# EasyEDA Pro project Cerberus_Sub_Controller_v01.eprj, board Cerberus_Sub_Controller_v01
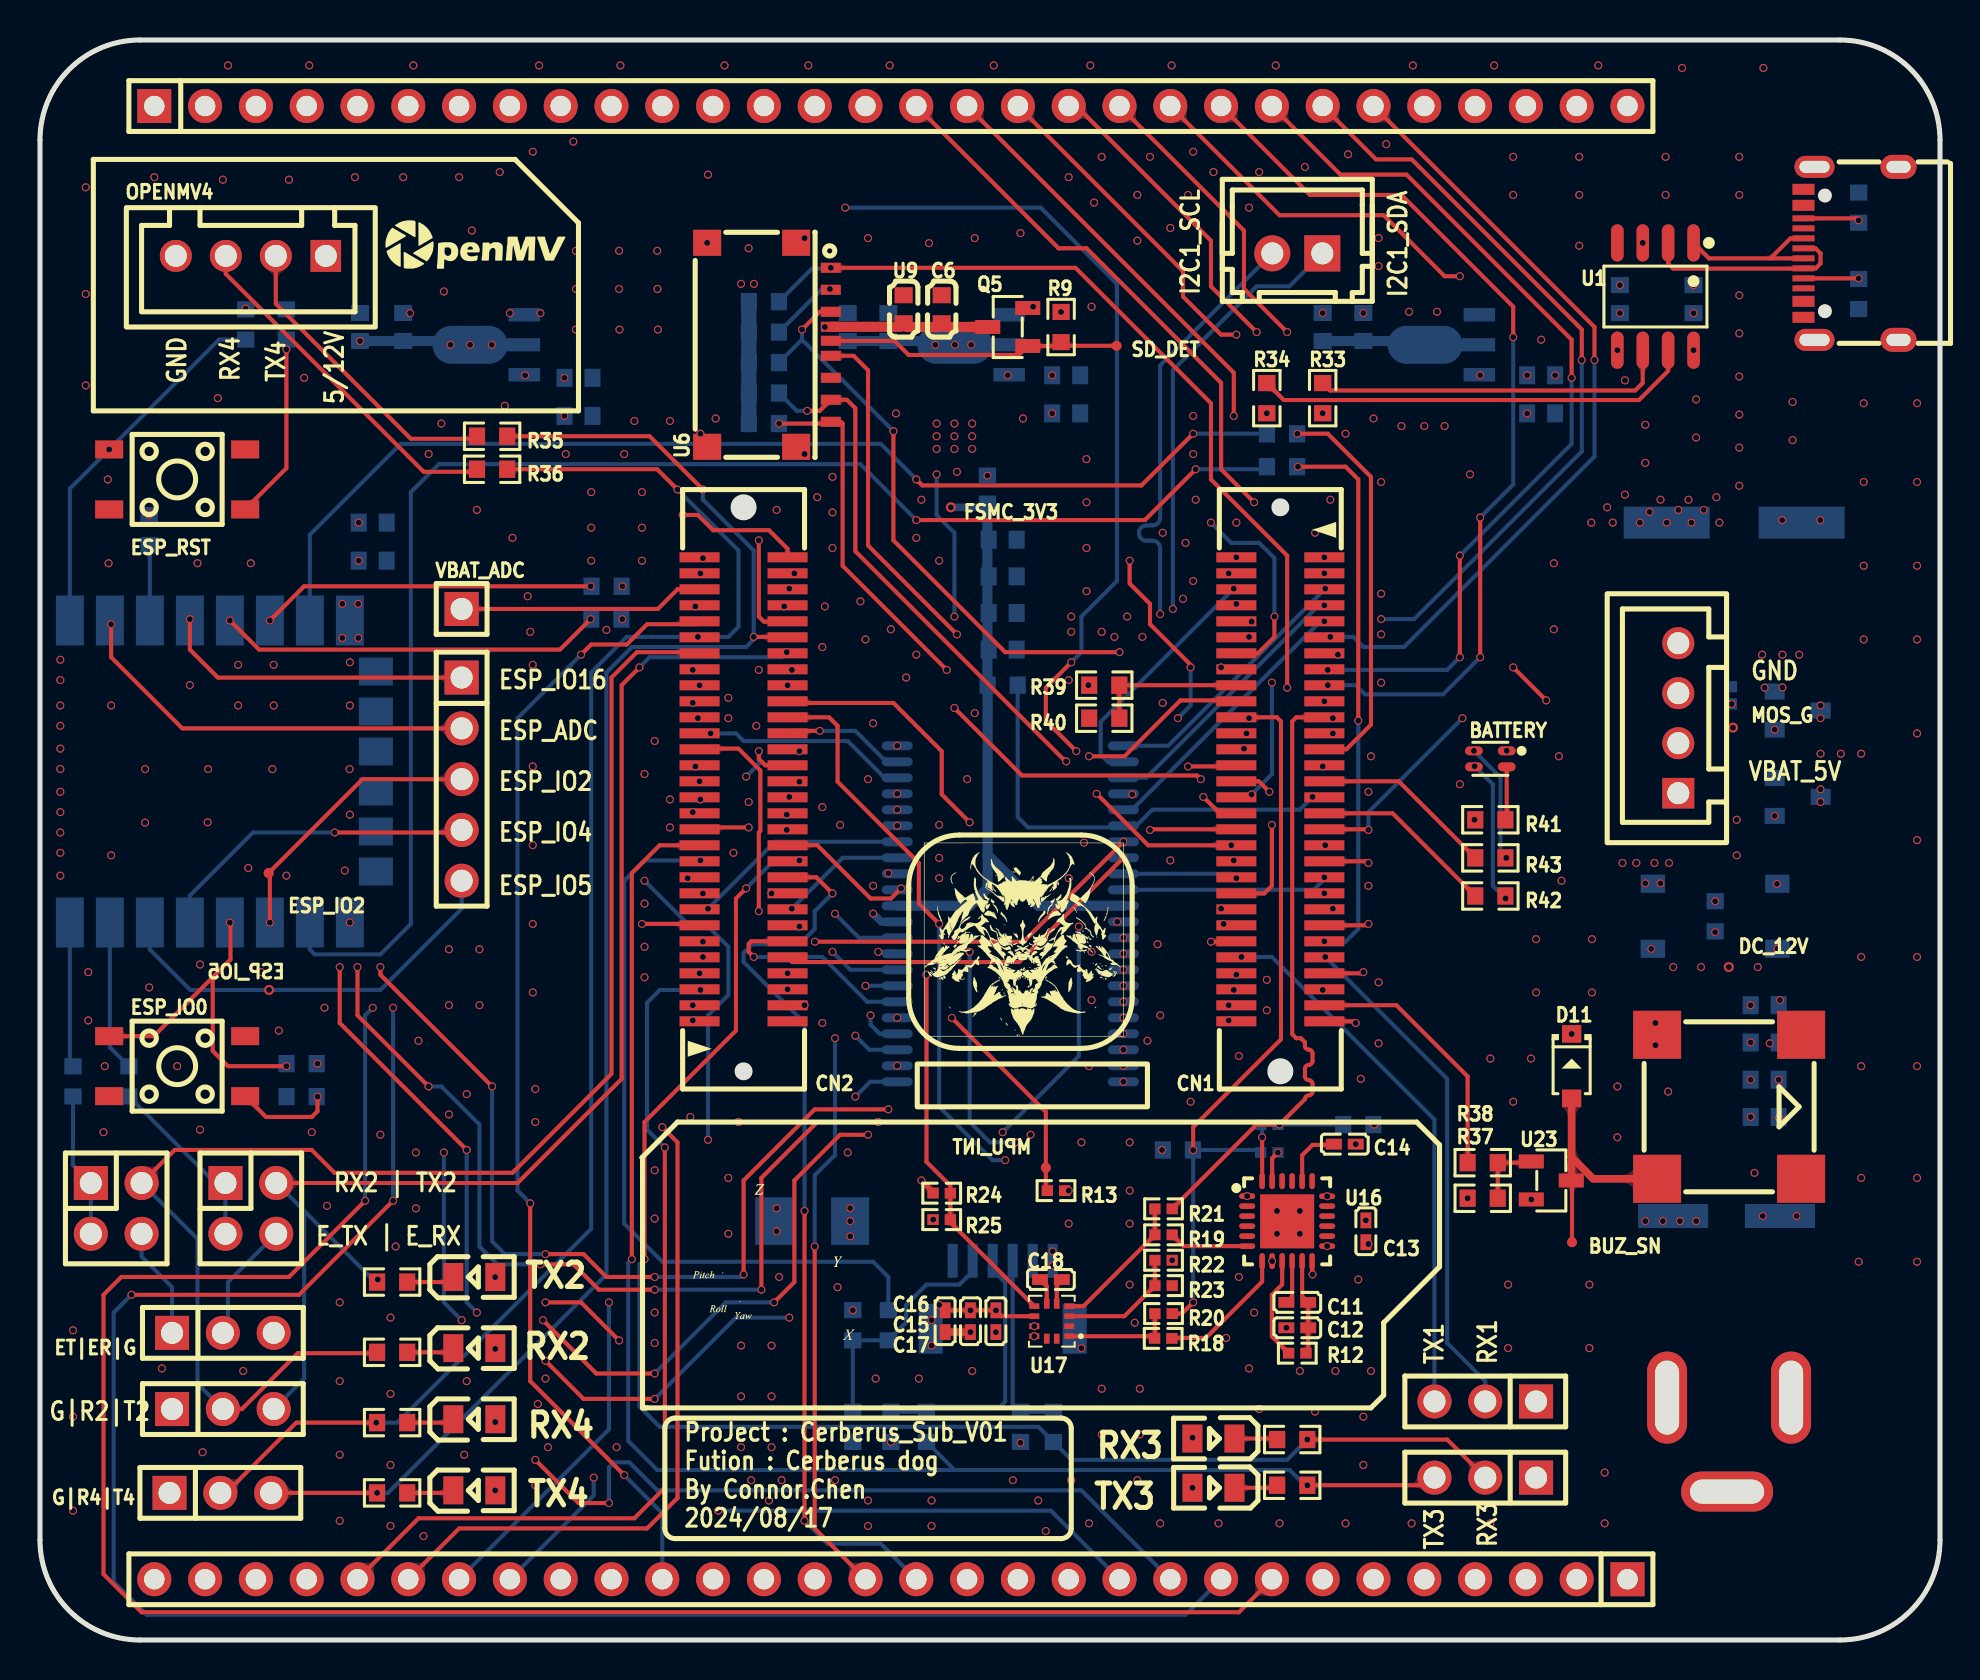
[diagram p4: board, top side]
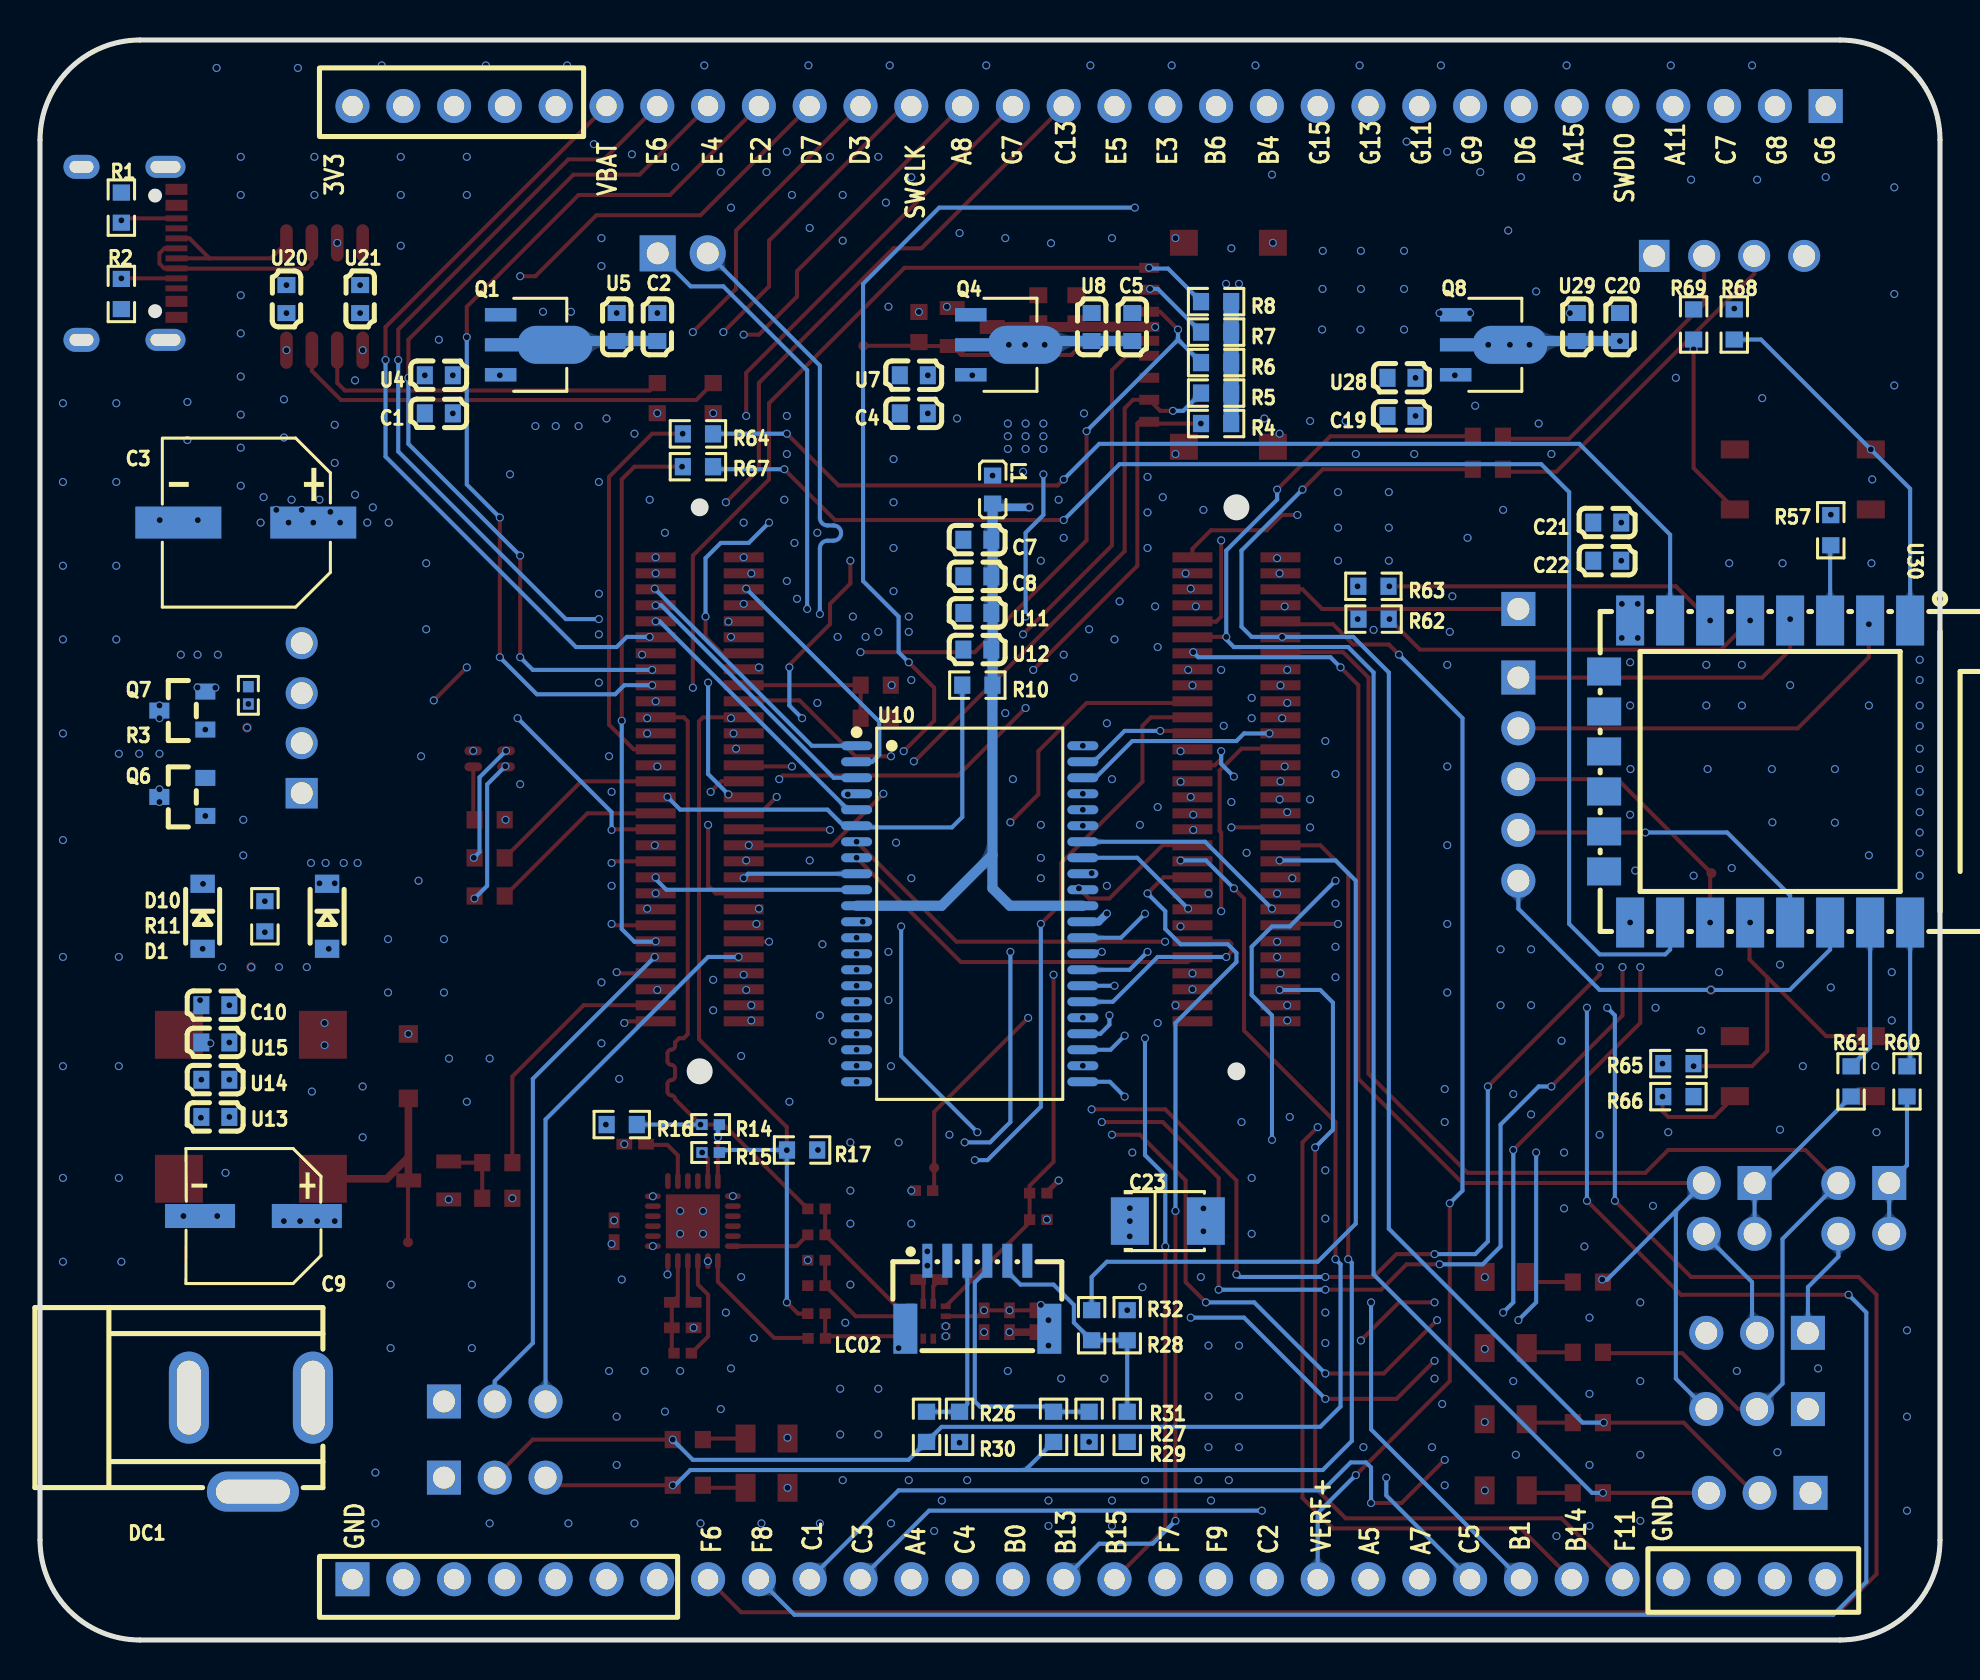
[diagram p5: board, bottom side, seen from below]

Outline 95 x 80 mm; copper layers: Top Layer, SN_IMT, GND, POWER, SN_NRM, Bottom Layer. Coordinates in mm from the lower left corner of the outline.
Outline path: 0,75 0,5 arc(1.46,1.46) 5,0 90,0 arc(93.54,1.46) 95,5 95,75 arc(93.54,78.54) 90,80 5,80 arc(1.46,78.54) 0,75
Stack: Top Layer 0.035mm 外层铜厚1oz / Dielectric1 0.0994mm 3313 RC57% 4.2mil / SN_IMT 0.0152mm 内层铜厚 / Dielectric2 0.55mm 0.55mm H/H不含铜 / GND 0.0152mm 内层铜厚 / Dielectric3 0.1088mm 2116 RC54% 4.9mil / POWER 0.0152mm 内层铜厚 / Dielectric4 0.55mm 0.55mm H/H不含铜 / SN_NRM 0.0152mm 内层铜厚 / Dielectric5 0.0994mm 3313 RC57% 4.2mil / Bottom Layer 0.035mm 外层铜厚1oz

## Design rules (mm)
template: 自定义配置
spacing copperThickness1oz (default): track to track 0.102, other pairs 0.152 to 0.3
spacing copperThickness2oz: track to track 0.203, other pairs 0.152 to 0.3
track width copperThickness1oz (default): min 0.127, default 0.254, max 2.54
track width copperThickness2oz: min 0.203, default 0.254, max 2.54
differential pair differentialPair (default): width min 0.127, default 0.254, max 2.54; gap min 0.152, default 0.152
via viaSize (default): diameter min 0.4, default 0.61, max 10; hole min 0.3, default 0.305, max 6.3
net GND uses 直连
net VCC_SUB_3V3 uses 直连
net VCC_5/12V uses 直连
net VCC_PER_3V3 uses 直连
net VCC_ESP_3V3 uses 直连
net VCC_DC_12V uses 直连
net VBAT_5V uses 直连
net VCC_SD_3V3 uses 直连
net $1N508 uses 直连

## Placement (name value [footprint] x y rotation side)
BATTERY  TZ-P4-1615RGBTCA1-0.55T  [LED-SMD_4P-L1.6-W1.5-BR_TZ-P4-1615]  72.52 44.06 90 top
BUZ_SN  -  [Test-Point-0.5mm]  76.6 19.89 0 top
BUZZER1  2.7kHz  [BUZ-SMD_4P-L8.5-W8.5-P8.50-BR]  84.46 26.66 270 top
C1  10uF  [C0603]  75.06 61.33 180 bottom
C2  10uF  [C0603]  64.13 65.65 270 bottom
C3  220uF  [CAP-SMD_BD8.0-L8.3-W8.3-LS9.5-FD]  84.71 55.87 0 bottom
C4  10uF  [C0603]  51.31 61.33 180 bottom
C5  10uF  [C0603]  40.39 65.65 270 bottom
C6  10uF  [C0603]  45.09 66.54 270 top
C7  22uF  [C0603]  48.13 55.01 180 bottom
C8  4.7uF  [C0603]  48.13 53.18 180 bottom
C9  100uF  [CAP-SMD_BD6.3-L6.6-W6.6-LS7.4-FD]  84.33 21.2 0 bottom
C10  10uF  [C0603]  86.23 31.74 180 bottom
C11  100nF  [C0402]  62.87 16.88 180 top
C12  100nF  [C0402]  62.87 15.61 180 top
C13  100nF  [C0402]  66.29 20.44 90 top
C14  2.2nF  [C0402]  65.24 24.79 0 top
C15  10uF  [C0402]  46.52 15.94 270 top
C16  100nF  [C0402]  47.79 15.94 90 top
C17  100nF  [C0402]  45.25 15.94 90 top
C18  220nF  [C0402]  50.55 18.02 0 top
C19  10uF  [C0603]  26.92 61.2 180 bottom
C20  10uF  [C0603]  16 65.65 270 bottom
C21  10uF  [C0603]  16.64 55.87 180 bottom
C22  100nF  [C0603]  16.64 53.97 180 bottom
C23  220uF  [CAP-SMD_L3.5-W2.8-R-RD]  38.61 20.94 0 bottom
CN1  X0802WVS-60AS-LPV01  [CONN-SMD_60P-P0.80_XKB_X0802WVS-60ADS-LPV01]  62.02 42.53 270 top
CN2  X0802WVS-60AS-LPV01  [CONN-SMD_60P-P0.80_XKB_X0802WVS-60ADS-LPV01]  35.18 42.53 90 top
CN4  ZX-XH2.54-2PZZ  [CONN-TH_2P-P2.50_HX25003-2A]  62.87 69.33 180 top
D1  1N5819W  [SOD-123_L2.7-W1.6-LS3.7-R-RD]  80.65 36.19 270 bottom
D10  1N5819W(NC)  [SOD-123_L2.7-W1.6-LS3.7-R-RD]  86.87 36.19 270 bottom
D11  1N4148W  [SOD-123_L2.7-W1.6-LS3.7-FD]  76.58 28.69 90 top
DC1  DC005  [DC-IN-TH_DC005]  84.46 9.77 180 bottom
DC_12V  -  [test-point-0.5mm]  84.44 33.65 0 top
ESP_IO0  TS-1009S-04526  [SW-SMD_4P-L4.5-W4.5-P3.00-LS7.0]  6.86 28.69 0 top
ESP_IO2  -  [Test-Point-0.5mm]  11.43 38.34 0 top
ESP_IO5  -  [test-point-0.5mm#2]  11.45 32.5 180 bottom
ESP_RST  TS-1009S-04526  [SW-SMD_4P-L4.5-W4.5-P3.00-LS7.0]  6.86 58.03 0 top
ET|ER|G  PZ254V-11-03P  [HDR-TH_3P-P2.54-V-M]  9.14 15.36 0 top
FSMC_3V3  -  [Test-Point-0.5mm]  45.54 56.63 90 top
G|R4|T4  PZ254V-11-03P  [HDR-TH_3P-P2.54-V-M]  9.02 7.36 0 top
H3  PZ254V-11-03P  [HDR-TH_3P-P2.54-V-M]  72.26 11.93 180 top
H5  PZ254V-11-03P  [HDR-TH_3P-P2.54-V-M]  72.26 8.12 180 top
H7  PZ254V-11-05P  [HDR-TH_5P-P2.54-V-M]  21.08 43.04 270 top
H8  PZ254V-12-4P  [HDR-TH_4P-P2.54-V-M-R2-C2-S2.54]  3.81 21.58 270 top
H9  PZ254V-12-4P  [HDR-TH_4P-P2.54-V-M-R2-C2-S2.54]  10.54 21.58 270 top
L1  600R 100Mhz  [L0603]  47.37 57.52 270 bottom
LC02  WAFER-SH1.0-6PWB  [CONN-SMD_6P-P1.00_XUNPU_WAFER-SH1.0-6PWB]  48.13 17.26 180 bottom
MOS_G  -  [test-point-0.5mm]  84.65 45.62 0 top
MPU_INT  -  [test-point-0.5mm#2]  50.29 23.61 180 bottom
NOREF  -  [HDR-TH_3P-P2.54-V-M]  9.14 11.55 0 top
OPENMV4  ZX-XH2.54-4PZZ  [CONN-TH_4P-P2.50_4PIN]  10.54 69.2 180 top
Q1  AMS1117-3.3V  [SOT-89-3_L4.5-W2.5-P1.50-LS4.2-BR]  70.61 64.76 0 bottom
Q4  AMS1117-3.3V  [SOT-89-3_L4.5-W2.5-P1.50-LS4.2-BR]  47.1 64.76 0 bottom
Q5  SI2305CDS-T1-GE3  [SOT-23-3_L2.9-W1.3-P1.90-LS2.4-BR]  48.39 65.65 0 top
Q6  AO3401A  [SOT-23_L2.9-W1.3-P1.90-LS2.4-BR]  87.88 42.15 180 bottom
Q7  AO3401A  [SOT-23_L2.9-W1.3-P1.90-LS2.4-BR]  87.88 46.47 180 bottom
Q8  AMS1117-3.3V  [SOT-89-3_L4.5-W2.5-P1.50-LS4.2-BR]  22.86 64.76 0 bottom
R1  5.1kΩ  [R0603]  90.93 71.62 90 bottom
R2  5.1kΩ  [R0603]  90.93 67.3 270 bottom
R3  1MΩ  [R0402]  84.58 47.23 270 bottom
R4  51kΩ  [R0603]  36.19 60.82 180 bottom
R5  51kΩ  [R0603]  36.19 62.35 180 bottom
R6  51kΩ  [R0603]  36.19 63.87 180 bottom
R7  51kΩ  [R0603]  36.19 65.39 180 bottom
R8  51kΩ  [R0603]  36.19 66.92 180 bottom
R9  10kΩ  [R0603]  51.05 65.65 90 top
R10  10kΩ  [R0603]  48.13 47.74 0 bottom
R11  0Ω  [R0603]  83.76 36.19 270 bottom
R12  10kΩ  [R0402]  62.87 14.34 180 top
R13  100Ω  [R0402]  50.8 22.47 0 top
R14  100Ω  [R0402]  61.47 25.77 0 bottom
R15  100Ω  [R0402]  61.47 24.37 180 bottom
R16  4.7kΩ  [R0603]  65.91 25.77 0 bottom
R17  4.7kΩ  [R0603]  56.9 24.5 180 bottom
R18  0Ω  [R0402]  56.16 15.08 0 top
R19  0Ω  [R0402]  56.18 20.26 0 top
R20  NC  [R0402]  56.18 16.32 0 top
R21  NC  [R0402]  56.18 21.56 0 top
R22  4.7kΩ  [R0402]  56.18 18.99 0 top
R23  NC  [R0402]  56.18 17.72 180 top
R24  4.7kΩ  [R0402]  45.09 22.34 180 top
R25  NC  [R0402]  45.09 21.02 0 top
R26  1kΩ  [R0603]  49.02 10.66 270 bottom
R27  1kΩ  [R0603]  42.54 10.66 270 bottom
R28  1kΩ(NC)  [R0603]  40.64 15.74 90 bottom
R29  0Ω  [R0603]  40.64 10.66 90 bottom
R30  0Ω  [R0603]  50.67 10.66 90 bottom
R31  0Ω  [R0603]  44.32 10.66 90 bottom
R32  0Ω(NC)  [R0603]  42.42 15.74 270 bottom
R33  0Ω  [R0603]  64.13 62.09 90 top
R34  0Ω  [R0603]  61.34 62.09 90 top
R35  0Ω  [R0603]  22.61 60.19 180 top
R36  0Ω  [R0603]  22.61 58.54 180 top
R37  10kΩ  [R0603]  72.14 22.09 0 top
R38  470Ω  [R0603]  72.14 23.87 0 top
R39  10kΩ  [R0603]  53.21 47.74 180 top
R40  10kΩ(NC)  [R0603]  53.21 46.09 0 top
R41  470Ω  [R0603]  72.52 41.01 0 top
R42  330Ω  [R0603]  72.52 37.2 180 top
R43  100Ω  [R0603]  72.52 39.11 180 top
R50  1kΩ  [R0603]  17.61 17.9 180 top
R51  1kΩ  [R0603]  17.61 14.38 180 top
R52  1kΩ  [R0603]  62.61 7.74 0 top
R53  1kΩ  [R0603]  62.61 10.02 0 top
R54  1kΩ  [R0603]  17.61 7.36 180 top
R55  1kΩ  [R0603]  17.61 10.87 180 top
R57  10kΩ  [R0603]  5.46 55.49 270 bottom
R60  0Ω  [R0603]  1.65 27.93 270 bottom
R61  0Ω  [R0603]  4.44 27.93 270 bottom
R62  0Ω  [R0603]  28.32 51.04 0 bottom
R63  0Ω  [R0603]  28.33 52.69 0 bottom
R64  0Ω  [R0603]  62.1 60.31 0 bottom
R65  10kΩ  [R0603]  13.08 28.82 0 bottom
R66  10kΩ  [R0603]  13.08 27.17 0 bottom
R67  0Ω  [R0603]  62.1 58.66 0 bottom
R68  10kΩ  [R0603]  10.29 65.78 90 bottom
R69  10kΩ  [R0603]  12.32 65.78 270 bottom
RX2  NCD0805R1  [LED0805-R-RD]  21.72 14.59 0 top
RX3  NCD0805R1  [LED0805-R-RD]  58.67 10.07 180 top
RX4  NCD0805R1  [LED0805-R-RD]  21.72 11.04 0 top
SD_DET  -  [Test-Point-0.5mm]  53.83 64.71 180 top
TX2  NCD0805R1  [LED0805-R-RD]  21.72 18.15 0 top
TX3  NCD0805R1  [LED0805-R-RD]  58.67 7.61 180 top
TX4  NCD0805R1  [LED0805-R-RD]  21.72 7.48 0 top
U1  CH340N  [SOP-8_L4.9-W3.9-P1.27-LS6.0-BL]  80.77 67.17 180 top
U2  ZX-XH2.54-4PZZ  [CONN-TH_4P-P2.50_4PIN]  81.91 46.09 90 top
U4  100nF  [C0603]  75.06 63.24 180 bottom
U5  100nF  [C0603]  66.17 65.65 270 bottom
U6  TF-123-ARP9H17  [TF-SMD_TF-123-ARP9H15]  36.45 64.76 90 top
U7  100nF  [C0603]  51.31 63.24 180 bottom
U8  100nF  [C0603]  42.42 65.65 270 bottom
U9  100nF  [C0603]  43.18 66.54 270 top
U10  IS62WV51216BLL-55TLI  [TSOP-44_L18.4-W10.2-P0.80-LS11.8-BL]  48.51 36.31 270 bottom
U11  100nF  [C0603]  48.13 51.35 180 bottom
U12  100nF  [C0603]  48.13 49.52 180 bottom
U13  100nF  [C0603]  86.23 26.15 180 bottom
U14  NC  [C0603]  86.23 28.01 180 bottom
U15  NC  [C0603]  86.23 29.88 180 bottom
U16  MPU-6050  [QFN-24_L4.0-W4.0-P0.50-BL-EP2.7]  62.36 20.94 270 top
U17  LIS2MDLTR  [LGA-12_L2.0-W2.0-P0.50-BL]  50.59 15.94 90 top
U20  100nF  [C0603]  82.68 67.05 270 bottom
U21  100nF  [C0603]  78.99 67.05 270 bottom
U23  SS8050  [SOT-23-3_L2.9-W1.3-P1.90-LS2.4-BR]  75.56 22.98 180 top
U24  X6511WV-30H-C60D30  [HDR-TH_30P-P2.54-V-M]  42.54 76.7 0 top
U25  X6511WV-30H-C60D30  [HDR-TH_30P-P2.54-V-M]  42.54 3.04 180 top
U28  100nF  [C0603]  26.92 63.11 180 bottom
U29  100nF  [C0603]  18.16 65.65 270 bottom
U30  2.4GHz  [WIFIM-SMD_ESP-12F-ESP8266MOD]  9.14 43.42 0 bottom
USB1  TYPE-C 16PIN 2MD(073)  [USB-C-SMD_TYPE-C-6PIN-2MD-073]  90.55 69.33 90 top
VBAT_ADC  PZ254V-11-01P  [HDR-TH_1P-P2.54-V-M]  21.08 51.55 0 top

## Footprints (pads in the part's own frame, mm; a bottom-side part is the same pattern mirrored in y, then rotated)
BUZ-SMD_4P-L8.5-W8.5-P8.50-BR
  rect 2.4x2.4 smd: 1(-3.6,-3.6) 2(3.6,-3.6) 3(3.599,3.599) 4(-3.6,3.6)
C0402
  rect 0.79x0.54 smd: 1(-0.545,0) 2(0.545,0)
C0603
  rect 0.8x0.9 smd: 1(-0.7,0) 2(0.7,0)
CAP-SMD_BD6.3-L6.6-W6.6-LS7.4-FD
  rect 3.5x1.2 smd: 1(-2.67,0) 2(2.67,0)
CAP-SMD_BD8.0-L8.3-W8.3-LS9.5-FD
  rect 4.3x1.6 smd: 1(-3.373,0) 2(3.373,0)
CAP-SMD_L3.5-W2.8-R-RD
  rect 1.9x2.376 smd: 1(1.899,0) 2(-1.899,0)
CONN-SMD_6P-P1.00_XUNPU_WAFER-SH1.0-6PWB
  rect 0.5x1.7 smd: 1(-2.5,1.7) 2(-1.5,1.7) 3(-0.5,1.7) 4(0.5,1.7) 5(1.5,1.7) 6(2.5,1.7)
  rect 1.2x2.5 smd: 7(3.6,-1.7) 8(-3.6,-1.7)
CONN-SMD_60P-P0.80_XKB_X0802WVS-60ADS-LPV01
  rect 0.5x2 smd: 1(-11.6,2.2) 2(-11.6,-2.2) 3(-10.8,2.2) 4(-10.8,-2.2) 5(-10,2.2) 6(-10,-2.2) 7(-9.2,2.2) 8(-9.2,-2.2) 9(-8.4,2.2) 10(-8.4,-2.2) 11(-7.6,2.2) 12(-7.6,-2.2) 13(-6.8,2.2) 14(-6.8,-2.2) 15(-6,2.2) 16(-6,-2.2) 17(-5.2,2.2) 18(-5.2,-2.2) 19(-4.4,2.2) 20(-4.4,-2.2) 21(-3.6,2.2) 22(-3.6,-2.2) 23(-2.8,2.2) 24(-2.8,-2.2) 25(-2,2.2) 26(-2,-2.2) 27(-1.2,2.2) 28(-1.2,-2.2) 29(-0.4,2.2) 30(-0.4,-2.2) 31(0.4,2.2) 32(0.4,-2.2) 33(1.2,2.2) 34(1.2,-2.2) 35(2,2.2) 36(2,-2.2) 37(2.8,2.2) 38(2.8,-2.2) 39(3.6,2.2) 40(3.6,-2.2) 41(4.4,2.2) 42(4.4,-2.2) 43(5.2,2.2) 44(5.2,-2.2) 45(6,2.2) 46(6,-2.2) 47(6.8,2.2) 48(6.8,-2.2) 49(7.6,2.2) 50(7.6,-2.2) 51(8.4,2.2) 52(8.4,-2.2) 53(9.2,2.2) 54(9.2,-2.2) 55(10,2.2) 56(10,-2.2) 57(10.8,2.2) 58(10.8,-2.2) 59(11.6,2.2) 60(11.6,-2.2)
CONN-TH_2P-P2.50_HX25003-2A
  rect 1.8x1.8 hole 1.1: 1(-1.25,0)
  round 1.8 hole 1.1: 2(1.25,0)
CONN-TH_4P-P2.50_4PIN
  rect 1.524x1.6 hole 1.1: 1(-3.75,0)
  round 1.6 hole 1.1: 2(-1.25,0) 3(1.25,0) 4(3.75,0)
DC-IN-TH_DC005
  oval 2x4.6 hole 1.2x3.7: 1(3.1,2.35) 2(-3.1,2.35)
  oval 4.6x2 hole 3.7x1.2: 3(0.1,-2.35)
HDR-TH_1P-P2.54-V-M
  rect 1.7x1.7 hole 1.1: 1(0,0)
HDR-TH_3P-P2.54-V-M
  rect 1.7x1.7 hole 1.1: 1(-2.54,0)
  round 1.7 hole 1.1: 2(0,0) 3(2.54,0)
HDR-TH_4P-P2.54-V-M-R2-C2-S2.54
  rect 1.7x1.7 hole 1.1: 1(-1.27,-1.27)
  round 1.7 hole 1.1: 2(-1.27,1.27) 3(1.27,-1.27) 4(1.27,1.27)
HDR-TH_5P-P2.54-V-M
  rect 1.7x1.7 hole 1.1: 1(-5.08,0)
  round 1.7 hole 1.1: 2(-2.54,0) 3(0,0) 4(2.54,0) 5(5.08,0)
HDR-TH_30P-P2.54-V-M
  rect 1.7x1.7 hole 1.02: 1(-36.83,0)
  round 1.7 hole 1.02: 2(-34.29,0) 3(-31.75,0) 4(-29.21,0) 5(-26.67,0) 6(-24.13,0) 7(-21.59,0) 8(-19.05,0) 9(-16.51,0) 10(-13.97,0) 11(-11.43,0) 12(-8.89,0) 13(-6.35,0) 14(-3.81,0) 15(-1.27,0) 16(1.27,0) 17(3.81,0) 18(6.35,0) 19(8.89,0) 20(11.43,0) 21(13.97,0) 22(16.51,0) 23(19.05,0) 24(21.59,0) 25(24.13,0) 26(26.67,0) 27(29.21,0) 28(31.75,0) 29(34.29,0) 30(36.83,0)
L0603
  rect 0.8x0.864 smd: 1(-0.7,0) 2(0.7,0)
LED0805-R-RD
  rect 1x1.399 smd: 1(1.05,0) 2(-1.05,0)
LED-SMD_4P-L1.6-W1.5-BR_TZ-P4-1615
  oval 0.448x0.889 smd: 1(0.4,-0.82) 2(-0.4,-0.82) 3(-0.4,0.82) 4(0.4,0.82)
LGA-12_L2.0-W2.0-P0.50-BL
  rect 0.28x0.5 smd: 1(-0.75,-0.875) 2(-0.25,-0.875) 3(0.25,-0.875) 4(0.75,-0.875) 7(0.75,0.875) 8(0.25,0.875) 9(-0.25,0.875) 10(-0.75,0.875)
  rect 0.5x0.28 smd: 5(0.875,-0.25) 6(0.875,0.25) 11(-0.875,0.25) 12(-0.875,-0.25)
QFN-24_L4.0-W4.0-P0.50-BL-EP2.7
  oval 0.28x0.8 smd: 1(-1.25,-2) 2(-0.75,-2) 3(-0.25,-2) 4(0.25,-2) 5(0.75,-2) 6(1.25,-2) 13(1.25,2) 14(0.75,2) 15(0.25,2) 16(-0.25,2) 17(-0.75,2) 18(-1.242,2)
  oval 0.8x0.28 smd: 7(2,-1.25) 8(2,-0.75) 9(2,-0.25) 10(2,0.25) 11(2,0.75) 12(2,1.25) 19(-2,1.25) 20(-2,0.75) 21(-2,0.25) 22(-2,-0.25) 23(-2,-0.75) 24(-2,-1.25)
  rect 2.7x2.7 smd: 25(0.013,0)
R0402
  rect 0.566x0.54 smd: 1(-0.433,0) 2(0.433,0)
R0603
  rect 0.806x0.864 smd: 1(-0.753,0) 2(0.753,0)
SOD-123_L2.7-W1.6-LS3.7-FD
  rect 0.88x0.96 smd: 1(-1.61,0) 2(1.61,0)
SOD-123_L2.7-W1.6-LS3.7-R-RD
  rect 0.909x1.219 smd: 1(1.625,0) 2(-1.625,0)
SOP-8_L4.9-W3.9-P1.27-LS6.0-BL
  oval 0.63x1.865 smd: 1(-1.905,-2.683) 2(-0.635,-2.683) 3(0.635,-2.683) 4(1.905,-2.683) 5(1.905,2.683) 6(0.635,2.683) 7(-0.635,2.683) 8(-1.905,2.683)
SOT-23-3_L2.9-W1.3-P1.90-LS2.4-BR
  rect 1.25x0.7 smd: 1(1,-0.95) 2(1,0.95) 3(-1,0)
SOT-23_L2.9-W1.3-P1.90-LS2.4-BR
  rect 1x0.8 smd: 1(1.15,-0.95) 2(1.15,0.95) 3(-1.15,0)
SOT-89-3_L4.5-W2.5-P1.50-LS4.2-BR
  rect 1.575x0.672 smd: 1(1.356,-1.5) 3(1.356,1.5)
  custom 5.377x1.9 smd: 2(-1.356,0)
SW-SMD_4P-L4.5-W4.5-P3.00-LS7.0
  rect 1.4x0.9 smd: 1(-3.4,1.5) 2(3.4,1.5) 3(-3.4,-1.5) 4(3.4,-1.5)
test-point-0.5mm
  round 0.5 smd: 1(0,0)
test-point-0.5mm#2
  round 0.5 smd far side: 1(0,0)
Test-Point-0.5mm
  round 0.5 smd: 1(0,0)
TF-SMD_TF-123-ARP9H15
  rect 0.5x1 smd: 1(3.85,-3.092) 2(2.75,-3.092) 3(1.65,-3.092) 4(0.9,-3.092) 5(-0.55,-3.092) 6(-1.65,-3.092) 7(-2.75,-3.092) 8(-3.85,-3.092) 9(0.2,-3.092)
  rect 1.3x1.4 smd: 10(-5.1,-1.357) 11(-5.1,3.092) 12(5.1,3.092) 13(5.1,-1.357)
TSOP-44_L18.4-W10.2-P0.80-LS11.8-BL
  oval 0.448x1.551 smd: 1(-8.4,-5.655) 2(-7.6,-5.655) 3(-6.8,-5.655) 4(-6,-5.655) 5(-5.2,-5.655) 6(-4.4,-5.655) 7(-3.6,-5.655) 8(-2.8,-5.655) 9(-2,-5.655) 10(-1.2,-5.655) 11(-0.4,-5.655) 12(0.4,-5.655) 13(1.2,-5.655) 14(2,-5.655) 15(2.8,-5.655) 16(3.6,-5.655) 17(4.4,-5.655) 18(5.2,-5.655) 19(6,-5.655) 20(6.8,-5.655) 21(7.6,-5.655) 22(8.4,-5.655) 23(8.4,5.655) 24(7.6,5.655) 25(6.8,5.655) 26(6,5.655) 27(5.2,5.655) 28(4.4,5.655) 29(3.6,5.655) 30(2.8,5.655) 31(2,5.655) 32(1.2,5.655) 33(0.4,5.655) 34(-0.4,5.655) 35(-1.2,5.655) 36(-2,5.655) 37(-2.8,5.655) 38(-3.6,5.655) 39(-4.4,5.655) 40(-5.2,5.655) 41(-6,5.655) 42(-6.8,5.655) 43(-7.6,5.655) 44(-8.4,5.655)
USB-C-SMD_TYPE-C-6PIN-2MD-073
  rect 0.55x1.1 smd: 1(-3.2,2.375) 2(-2.4,2.375) 11(2.4,2.375) 12(3.2,2.375)
  rect 0.3x1.1 smd: 3(-1.75,2.375) 4(-1.25,2.375) 5(-0.75,2.375) 6(-0.25,2.375) 7(0.25,2.375) 8(0.75,2.375) 9(1.25,2.375) 10(1.75,2.375)
  oval 1.1x2 hole 0.6x1.5: 13(-4.325,1.825) 14(4.325,1.825)
  oval 1.2x1.8 hole 0.6x1.2: 13(-4.325,-2.375) 14(4.325,-2.375)
WIFIM-SMD_ESP-12F-ESP8266MOD
  rect 1.4x2.5 smd: 1(-7.651,-7.551) 2(-5.651,-7.551) 3(-3.651,-7.551) 4(-1.651,-7.551) 5(0.349,-7.551) 6(2.349,-7.551) 7(4.349,-7.551) 8(6.349,-7.551) 9(6.349,7.548) 10(4.349,7.55) 11(2.349,7.551) 12(0.349,7.551) 13(-1.651,7.55) 14(-3.651,7.551) 15(-5.651,7.551) 16(-7.651,7.551)
  rect 1.7x1.4 smd: 17(7.651,-5) 18(7.649,-3.002) 19(7.649,-1.004) 20(7.649,0.998) 21(7.649,2.997) 22(7.651,4.997)

## Nets
GND: C1.1 C2.1 C3.2 C4.1 C5.1 C6.1 C7.1 C8.1 C9.2 C10.1 C11.1 C12.1 C13.2 C14.2 C15.1 C16.2 C17.2 C18.1 C19.1 C20.1 C21.1 C22.1 C23.2 CN2.1 CN2.2 CN2.3 CN2.4 DC1.2 DC1.3 ET|ER|G.3 G|R4|T4.1 H3.1 H5.1 LC02.2 LC02.7 LC02.8 NOREF.1 OPENMV4.4 Q1.1 Q4.1 Q8.1 R1.2 R2.2 R3.1 R12.1 R23.1 R25.1 R29.1 R37.1 R40.1 R66.1 R69.1 U1.3 U2.3 U2.4 U4.1 U5.1 U6.6 U6.10 U6.11 U6.12 U6.13 U7.1 U8.1 U9.1 U10.12 U10.33 U11.1 U12.1 U13.1 U14.1 U15.1 U16.1 U16.11 U16.18 U16.25 U17.6 U17.8 U20.1 U21.1 U23.2 U25.1 U25.2 U25.3 U25.4 U25.5 U25.6 U25.7 U25.27 U25.28 U25.29 U25.30 U28.1 U29.1 U30.9 USB1.1 USB1.12 USB1.13 USB1.14
VBAT: CN1.11 CN1.12 U24.25
VBAT_5V: Q6.2 U2.1 U2.2
VCC_5/12V: C1.2 C3.1 C4.2 C19.2 D1.2 OPENMV4.1 Q1.3 Q4.3 Q7.2 Q8.3 U4.2 U7.2 U28.2
VCC_DC_12V: C9.1 C10.2 D1.1 D10.1 DC1.1 DC_12V.1 R11.2 U13.2 U14.2 U15.2
VCC_ESP_3V3: C20.2 C21.2 C22.2 Q8.2 R57.1 R65.2 R68.2 RX2.1 RX4.1 TX2.1 TX4.1 U29.2 U30.8
VCC_FSMC_3V3: C7.2 C8.2 FSMC_3V3.1 L1.2 R10.1 U10.11 U10.34 U11.2 U12.2
VCC_PER_3V3: C5.2 C15.2 C16.1 C17.1 C23.1 L1.1 LC02.1 Q4.2 Q5.2 R9.2 R24.2 R26.2 R27.2 R28.2 U8.2 U17.9 U17.10
VCC_SD_3V3: C6.2 Q5.3 R4.2 R5.2 R6.2 R7.2 R8.2 U6.4 U9.2
VCC_SUB_3V3: BATTERY.1 BUZZER1.1 C2.2 C12.2 C13.1 CN1.1 CN1.2 CN1.3 D11.2 Q1.2 R16.2 R17.2 R22.2 R39.2 RX3.1 TX3.1 U1.5 U1.8 U5.2 U16.8 U16.13 U20.2 U21.2 U24.26 U24.27 U24.28 U24.29 U24.30
ADC123_IN10: CN2.55 VBAT_ADC.1
D+: U1.1 USB1.6 USB1.8
D-: U1.2 USB1.5 USB1.7
ESP_ADC: H7.2 U30.2
ESP_IO0: ESP_IO0.1 R65.1 U30.12
ESP_IO2: ESP_IO2.1 H7.3 U30.11
ESP_IO4: H7.4 U30.13
ESP_IO5: ESP_IO5.1 H7.5 U30.14
ESP_IO16: H7.1 U30.4
ESP_RST: ESP_RST.1 R68.1 U30.1
ESP_RX0: R61.1 U30.15
ESP_RX0_E: ET|ER|G.2 H9.4
ESP_SPI_CLK: R62.1 U30.5
ESP_SPI_CS: R67.1 U30.10
ESP_SPI_MISO: R63.1 U30.6
ESP_SPI_MOSI: R64.1 U30.7
ESP_TX0: R60.1 U30.16
ESP_TX0_E: ET|ER|G.1 H8.4
FSMC_A0: CN1.9 U10.5
FSMC_A1: CN1.8 U10.4
FSMC_A2: CN1.7 U10.3
FSMC_A3: CN1.6 U10.2
FSMC_A4: CN1.5 U10.1
FSMC_A5: CN1.4 U10.44
FSMC_A6: CN2.38 U10.43
FSMC_A7: CN2.37 U10.42
FSMC_A8: CN2.36 U10.27
FSMC_A9: CN2.35 U10.26
FSMC_A10: CN2.34 U10.25
FSMC_A11: CN2.33 U10.24
FSMC_A12: CN2.9 U10.22
FSMC_A13: CN2.8 U10.21
FSMC_A14: CN2.7 U10.20
FSMC_A15: CN2.6 U10.19
FSMC_A16: CN2.14 U10.18
FSMC_A17: CN2.13 U10.23
FSMC_A18: CN2.12 U10.28
FSMC_CS1#: CN1.31 R10.2 U10.6
FSMC_D0: CN2.11 U10.7
FSMC_D1: CN2.10 U10.8
FSMC_D2: CN1.42 U10.9
FSMC_D3: CN1.41 U10.10
FSMC_D4: CN2.32 U10.13
FSMC_D5: CN2.31 U10.14
FSMC_D6: CN2.30 U10.15
FSMC_D7: CN2.29 U10.16
FSMC_D8: CN2.28 U10.29
FSMC_D9: CN2.27 U10.30
FSMC_D10: CN2.26 U10.31
FSMC_D11: CN2.25 U10.32
FSMC_D12: CN2.24 U10.35
FSMC_D13: CN2.17 U10.36
FSMC_D14: CN2.16 U10.37
FSMC_D15: CN2.15 U10.38
FSMC_LB#: CN1.20 U10.39
FSMC_OE#: CN1.38 U10.41
FSMC_UB#: CN1.19 U10.40
FSMC_WE#: CN1.37 U10.17
I2C1_SCL: CN1.22 CN4.2 R15.2 R17.1 R20.2
I2C1_SDA: CN1.21 CN4.1 R14.2 R16.1 R21.2
LC02_CS: CN2.21 R32.1
LC02_CS_R: LC02.5 R28.1 R29.2 R32.2
LC02_RXD: LC02.4 R27.1 R31.2
LC02_TXD: LC02.3 R26.1 R30.2
LIS_CS: R22.1 R23.2 U17.3
LIS_SCL: R18.1 R20.1 U17.1
LIS_SDA: R19.1 R21.1 U17.4
MPU6050_AUX_CL: R18.2 U16.7
MPU6050_AUX_DA: R19.2 U16.6
MPU6050_INT: CN2.56 MPU_INT.1 R13.1
PA0: CN2.50 G|R4|T4.3 R35.1 R54.2
PA1: CN2.49 G|R4|T4.2 R36.1 R55.2
PA2: CN2.48 H9.2 NOREF.3 R50.2
PA3: CN2.47 H8.2 NOREF.2 R51.2
PA4: CN2.46 U25.12
PA5: CN2.45 U25.21
PA6: CN2.44 R24.1 R25.2 R63.2 U17.7
PA7: CN2.43 U25.22
PA8: CN1.53 U24.18
PA9: CN1.52 H3.3 R34.1
PA10: CN1.51 H3.2 R33.1
PA11: CN1.50 U24.4
PA12: CN1.49 R67.2
PA15: CN1.46 U24.6
PB0: CN2.40 U25.14
PB1: CN2.39 U25.24
PB3: CN1.27 R62.2
PB4: CN1.26 U24.12
PB5: CN1.25 R64.2
PB6: CN1.24 U24.13
PB7: CN1.23 R41.1
PB10: CN2.23 H5.3 R31.1 R52.2
PB11: CN2.22 H5.2 R30.1 R53.2
PB13: CN2.20 U25.15
PB14: CN2.19 U25.25
PB15: CN2.18 U25.16
PC1: CN2.54 U25.10
PC2: CN2.53 U25.19
PC3: CN2.52 U25.11
PC4: CN2.42 U25.13
PC5: CN2.41 U25.23
PC6: CN1.57 R38.1
PC7: CN1.56 U24.3
PC8: CN1.55 R5.1 U6.7
PC9: CN1.54 R4.1 U6.8
PC10: CN1.45 R8.1 U6.1
PC11: CN1.44 R7.1 U6.2
PC12: CN1.43 U6.5
PC13: CN1.10 U24.16
PD2: CN1.40 R6.1 U6.3
PD3: CN1.39 U24.20
PD6: CN1.36 U24.7